# Altium schematic sheet ZYNQ_US_SOC_PL_GTX.SchDoc (part 2 of 3)
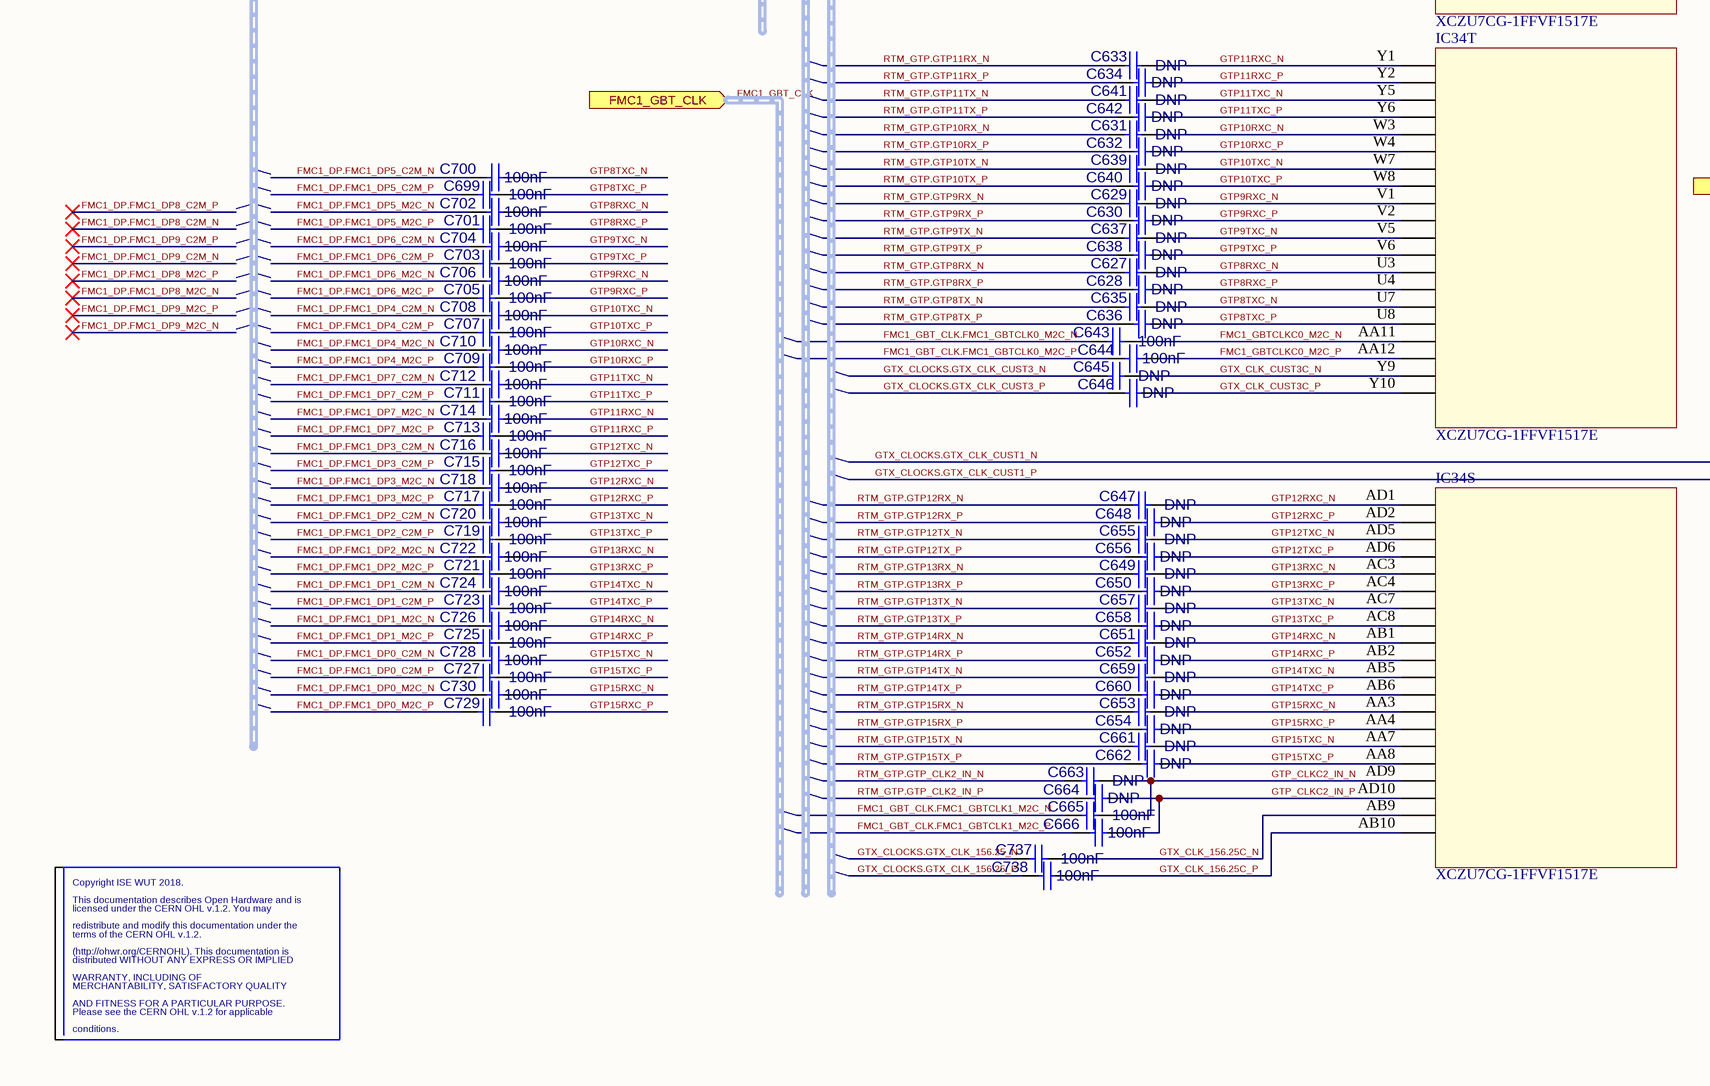
[diagram p3: ZYNQ_US_SOC_PL_GTX.SchDoc, bottom left]
## Library data of the parts
C176 = CAPC0603X33N: Capacitor - non polarized CAPC0603X33N DNP; Manufacturer Part Number: CC0201_100NF_6.3V_10%_X5R; Manufacturer: GENERIC; Part Description: SMD Multilayer Chip Ceramic Capacitor; CmpIndex: 1238; DXDB_LIBNAME: Capacitors SMD; Ref Designator: C176; SymIndex: 331; Tolerance: ±10%; Cell Name: CAPC0603X33N; Part Name: Capacitor - non polarized CAPC0603X33N; Part Number: Capacitor - non polarized CAPC0603X33N; Orientation: 0 = 0
C177 = CAPC0603X33N: Capacitor - non polarized CAPC0603X33N DNP; Manufacturer Part Number: CC0201_100NF_6.3V_10%_X5R; Manufacturer: GENERIC; Part Description: SMD Multilayer Chip Ceramic Capacitor; CmpIndex: 1240; DXDB_LIBNAME: Capacitors SMD; Ref Designator: C177; SymIndex: 331; Tolerance: ±10%; Cell Name: CAPC0603X33N; Part Name: Capacitor - non polarized CAPC0603X33N; Part Number: Capacitor - non polarized CAPC0603X33N; Orientation: 0 = 0
C178 = CAPC0603X33N: Capacitor - non polarized CAPC0603X33N DNP; Manufacturer Part Number: CC0201_100NF_6.3V_10%_X5R; Manufacturer: GENERIC; Part Description: SMD Multilayer Chip Ceramic Capacitor; CmpIndex: 1236; DXDB_LIBNAME: Capacitors SMD; Ref Designator: C178; SymIndex: 331; Tolerance: ±10%; Cell Name: CAPC0603X33N; Part Name: Capacitor - non polarized CAPC0603X33N; Part Number: Capacitor - non polarized CAPC0603X33N; Orientation: 0 = 0
C179 = CAPC0603X33N: Capacitor - non polarized CAPC0603X33N DNP; Manufacturer Part Number: CC0201_100NF_6.3V_10%_X5R; Manufacturer: GENERIC; Part Description: SMD Multilayer Chip Ceramic Capacitor; CmpIndex: 1241; DXDB_LIBNAME: Capacitors SMD; Ref Designator: C179; SymIndex: 331; Tolerance: ±10%; Cell Name: CAPC0603X33N; Part Name: Capacitor - non polarized CAPC0603X33N; Part Number: Capacitor - non polarized CAPC0603X33N; Orientation: 0 = 0
C181 = CAPC0603X33N: Capacitor - non polarized CAPC0603X33N DNP; Manufacturer Part Number: CC0201_100NF_6.3V_10%_X5R; Manufacturer: GENERIC; Part Description: SMD Multilayer Chip Ceramic Capacitor; CmpIndex: 1243; DXDB_LIBNAME: Capacitors SMD; Ref Designator: C181; SymIndex: 331; Tolerance: ±10%; Cell Name: CAPC0603X33N; Part Name: Capacitor - non polarized CAPC0603X33N; Part Number: Capacitor - non polarized CAPC0603X33N; Orientation: 0 = 0
C215 = CAPC0603X33N: Capacitor - non polarized CAPC0603X33N DNP; Manufacturer Part Number: CC0201_100NF_6.3V_10%_X5R; Manufacturer: GENERIC; Part Description: SMD Multilayer Chip Ceramic Capacitor; CmpIndex: 1242; DXDB_LIBNAME: Capacitors SMD; Ref Designator: C215; SymIndex: 331; Tolerance: ±10%; Cell Name: CAPC0603X33N; Part Name: Capacitor - non polarized CAPC0603X33N; Part Number: Capacitor - non polarized CAPC0603X33N; Orientation: 0 = 0
C264 = CAPC0603X33N: Capacitor - non polarized CAPC0603X33N DNP; Manufacturer Part Number: CC0201_100NF_6.3V_10%_X5R; Manufacturer: GENERIC; Part Description: SMD Multilayer Chip Ceramic Capacitor; CmpIndex: 1237; DXDB_LIBNAME: Capacitors SMD; Ref Designator: C264; SymIndex: 331; Tolerance: ±10%; Cell Name: CAPC0603X33N; Part Name: Capacitor - non polarized CAPC0603X33N; Part Number: Capacitor - non polarized CAPC0603X33N; Orientation: 0 = 0
C265 = CAPC0603X33N: Capacitor - non polarized CAPC0603X33N DNP; Manufacturer Part Number: CC0201_100NF_6.3V_10%_X5R; Manufacturer: GENERIC; Part Description: SMD Multilayer Chip Ceramic Capacitor; CmpIndex: 1239; DXDB_LIBNAME: Capacitors SMD; Ref Designator: C265; SymIndex: 331; Tolerance: ±10%; Cell Name: CAPC0603X33N; Part Name: Capacitor - non polarized CAPC0603X33N; Part Number: Capacitor - non polarized CAPC0603X33N; Orientation: 0 = 0
C266 = CAPC0603X33N: Capacitor - non polarized CAPC0603X33N DNP; Manufacturer Part Number: CC0201_100NF_6.3V_10%_X5R; Manufacturer: GENERIC; Part Description: SMD Multilayer Chip Ceramic Capacitor; CmpIndex: 1245; DXDB_LIBNAME: Capacitors SMD; Ref Designator: C266; SymIndex: 331; Tolerance: ±10%; Cell Name: CAPC0603X33N; Part Name: Capacitor - non polarized CAPC0603X33N; Part Number: Capacitor - non polarized CAPC0603X33N; Orientation: 0 = 0
C267 = CAPC0603X33N: Capacitor - non polarized CAPC0603X33N DNP; Manufacturer Part Number: CC0201_100NF_6.3V_10%_X5R; Manufacturer: GENERIC; Part Description: SMD Multilayer Chip Ceramic Capacitor; CmpIndex: 1246; DXDB_LIBNAME: Capacitors SMD; Ref Designator: C267; SymIndex: 331; Tolerance: ±10%; Cell Name: CAPC0603X33N; Part Name: Capacitor - non polarized CAPC0603X33N; Part Number: Capacitor - non polarized CAPC0603X33N; Orientation: 0 = 0
C268 = CAPC0603X33N: Capacitor - non polarized CAPC0603X33N DNP; Manufacturer Part Number: CC0201_100NF_6.3V_10%_X5R; Manufacturer: GENERIC; Part Description: SMD Multilayer Chip Ceramic Capacitor; CmpIndex: 1249; DXDB_LIBNAME: Capacitors SMD; Ref Designator: C268; SymIndex: 331; Tolerance: ±10%; Cell Name: CAPC0603X33N; Part Name: Capacitor - non polarized CAPC0603X33N; Part Number: Capacitor - non polarized CAPC0603X33N; Orientation: 0 = 0
C269 = CAPC0603X33N: Capacitor - non polarized CAPC0603X33N DNP; Manufacturer Part Number: CC0201_100NF_6.3V_10%_X5R; Manufacturer: GENERIC; Part Description: SMD Multilayer Chip Ceramic Capacitor; CmpIndex: 1250; DXDB_LIBNAME: Capacitors SMD; Ref Designator: C269; SymIndex: 331; Tolerance: ±10%; Cell Name: CAPC0603X33N; Part Name: Capacitor - non polarized CAPC0603X33N; Part Number: Capacitor - non polarized CAPC0603X33N; Orientation: 0 = 0
C270 = CAPC0603X33N: Capacitor - non polarized CAPC0603X33N DNP; Manufacturer Part Number: CC0201_100NF_6.3V_10%_X5R; Manufacturer: GENERIC; Part Description: SMD Multilayer Chip Ceramic Capacitor; CmpIndex: 1248; DXDB_LIBNAME: Capacitors SMD; Ref Designator: C270; SymIndex: 331; Tolerance: ±10%; Cell Name: CAPC0603X33N; Part Name: Capacitor - non polarized CAPC0603X33N; Part Number: Capacitor - non polarized CAPC0603X33N; Orientation: 0 = 0
C271 = CAPC0603X33N: Capacitor - non polarized CAPC0603X33N DNP; Manufacturer Part Number: CC0201_100NF_6.3V_10%_X5R; Manufacturer: GENERIC; Part Description: SMD Multilayer Chip Ceramic Capacitor; CmpIndex: 1244; DXDB_LIBNAME: Capacitors SMD; Ref Designator: C271; SymIndex: 331; Tolerance: ±10%; Cell Name: CAPC0603X33N; Part Name: Capacitor - non polarized CAPC0603X33N; Part Number: Capacitor - non polarized CAPC0603X33N; Orientation: 0 = 0
C272 = CAPC0603X33N: Capacitor - non polarized CAPC0603X33N DNP; Manufacturer Part Number: CC0201_100NF_6.3V_10%_X5R; Manufacturer: GENERIC; Part Description: SMD Multilayer Chip Ceramic Capacitor; CmpIndex: 1247; DXDB_LIBNAME: Capacitors SMD; Ref Designator: C272; SymIndex: 331; Tolerance: ±10%; Cell Name: CAPC0603X33N; Part Name: Capacitor - non polarized CAPC0603X33N; Part Number: Capacitor - non polarized CAPC0603X33N; Orientation: 0 = 0
C273 = CAPC0603X33N: Capacitor - non polarized CAPC0603X33N DNP; Manufacturer Part Number: CC0201_100NF_6.3V_10%_X5R; Manufacturer: GENERIC; Part Description: SMD Multilayer Chip Ceramic Capacitor; CmpIndex: 1251; DXDB_LIBNAME: Capacitors SMD; Ref Designator: C273; SymIndex: 331; Tolerance: ±10%; Cell Name: CAPC0603X33N; Part Name: Capacitor - non polarized CAPC0603X33N; Part Number: Capacitor - non polarized CAPC0603X33N; Orientation: 0 = 0
C579 = CAPC0603X33N: Capacitor - non polarized CAPC0603X33N DNP; Manufacturer Part Number: CC0201_100NF_6.3V_10%_X5R; Manufacturer: GENERIC; Part Description: SMD Multilayer Chip Ceramic Capacitor; CmpIndex: 654; DXDB_LIBNAME: Capacitors SMD; Ref Designator: C579; SymIndex: 331; Tolerance: ±10%; Cell Name: CAPC0603X33N; Part Name: Capacitor - non polarized CAPC0603X33N; Part Number: Capacitor - non polarized CAPC0603X33N; Orientation: 0 = 0
C580 = CAPC0603X33N: Capacitor - non polarized CAPC0603X33N DNP; Manufacturer Part Number: CC0201_100NF_6.3V_10%_X5R; Manufacturer: GENERIC; Part Description: SMD Multilayer Chip Ceramic Capacitor; CmpIndex: 706; DXDB_LIBNAME: Capacitors SMD; Ref Designator: C580; SymIndex: 331; Tolerance: ±10%; Cell Name: CAPC0603X33N; Part Name: Capacitor - non polarized CAPC0603X33N; Part Number: Capacitor - non polarized CAPC0603X33N; Orientation: 0 = 0
C581 = CAPC0603X33N: Capacitor - non polarized CAPC0603X33N DNP; Manufacturer Part Number: CC0201_100NF_6.3V_10%_X5R; Manufacturer: GENERIC; Part Description: SMD Multilayer Chip Ceramic Capacitor; CmpIndex: 707; DXDB_LIBNAME: Capacitors SMD; Ref Designator: C581; SymIndex: 331; Tolerance: ±10%; Cell Name: CAPC0603X33N; Part Name: Capacitor - non polarized CAPC0603X33N; Part Number: Capacitor - non polarized CAPC0603X33N; Orientation: 0 = 0
C582 = CAPC0603X33N: Capacitor - non polarized CAPC0603X33N DNP; Manufacturer Part Number: CC0201_100NF_6.3V_10%_X5R; Manufacturer: GENERIC; Part Description: SMD Multilayer Chip Ceramic Capacitor; CmpIndex: 731; DXDB_LIBNAME: Capacitors SMD; Ref Designator: C582; SymIndex: 331; Tolerance: ±10%; Cell Name: CAPC0603X33N; Part Name: Capacitor - non polarized CAPC0603X33N; Part Number: Capacitor - non polarized CAPC0603X33N; Orientation: 0 = 0
C583 = CAPC0603X33N: Capacitor - non polarized CAPC0603X33N DNP; Manufacturer Part Number: CC0201_100NF_6.3V_10%_X5R; Manufacturer: GENERIC; Part Description: SMD Multilayer Chip Ceramic Capacitor; CmpIndex: 763; DXDB_LIBNAME: Capacitors SMD; Ref Designator: C583; SymIndex: 331; Tolerance: ±10%; Cell Name: CAPC0603X33N; Part Name: Capacitor - non polarized CAPC0603X33N; Part Number: Capacitor - non polarized CAPC0603X33N; Orientation: 0 = 0
C584 = CAPC0603X33N: Capacitor - non polarized CAPC0603X33N DNP; Manufacturer Part Number: CC0201_100NF_6.3V_10%_X5R; Manufacturer: GENERIC; Part Description: SMD Multilayer Chip Ceramic Capacitor; CmpIndex: 764; DXDB_LIBNAME: Capacitors SMD; Ref Designator: C584; SymIndex: 331; Tolerance: ±10%; Cell Name: CAPC0603X33N; Part Name: Capacitor - non polarized CAPC0603X33N; Part Number: Capacitor - non polarized CAPC0603X33N; Orientation: 0 = 0
C585 = CAPC0603X33N: Capacitor - non polarized CAPC0603X33N DNP; Manufacturer Part Number: CC0201_100NF_6.3V_10%_X5R; Manufacturer: GENERIC; Part Description: SMD Multilayer Chip Ceramic Capacitor; CmpIndex: 765; DXDB_LIBNAME: Capacitors SMD; Ref Designator: C585; SymIndex: 331; Tolerance: ±10%; Cell Name: CAPC0603X33N; Part Name: Capacitor - non polarized CAPC0603X33N; Part Number: Capacitor - non polarized CAPC0603X33N; Orientation: 0 = 0
C586 = CAPC0603X33N: Capacitor - non polarized CAPC0603X33N DNP; Manufacturer Part Number: CC0201_100NF_6.3V_10%_X5R; Manufacturer: GENERIC; Part Description: SMD Multilayer Chip Ceramic Capacitor; CmpIndex: 766; DXDB_LIBNAME: Capacitors SMD; Ref Designator: C586; SymIndex: 331; Tolerance: ±10%; Cell Name: CAPC0603X33N; Part Name: Capacitor - non polarized CAPC0603X33N; Part Number: Capacitor - non polarized CAPC0603X33N; Orientation: 0 = 0
C587 = CAPC0603X33N: Capacitor - non polarized CAPC0603X33N DNP; Manufacturer Part Number: CC0201_100NF_6.3V_10%_X5R; Manufacturer: GENERIC; Part Description: SMD Multilayer Chip Ceramic Capacitor; CmpIndex: 767; DXDB_LIBNAME: Capacitors SMD; Ref Designator: C587; SymIndex: 331; Tolerance: ±10%; Cell Name: CAPC0603X33N; Part Name: Capacitor - non polarized CAPC0603X33N; Part Number: Capacitor - non polarized CAPC0603X33N; Orientation: 0 = 0
C588 = CAPC0603X33N: Capacitor - non polarized CAPC0603X33N DNP; Manufacturer Part Number: CC0201_100NF_6.3V_10%_X5R; Manufacturer: GENERIC; Part Description: SMD Multilayer Chip Ceramic Capacitor; CmpIndex: 768; DXDB_LIBNAME: Capacitors SMD; Ref Designator: C588; SymIndex: 331; Tolerance: ±10%; Cell Name: CAPC0603X33N; Part Name: Capacitor - non polarized CAPC0603X33N; Part Number: Capacitor - non polarized CAPC0603X33N; Orientation: 0 = 0
C589 = CAPC0603X33N: Capacitor - non polarized CAPC0603X33N DNP; Manufacturer Part Number: CC0201_100NF_6.3V_10%_X5R; Manufacturer: GENERIC; Part Description: SMD Multilayer Chip Ceramic Capacitor; CmpIndex: 769; DXDB_LIBNAME: Capacitors SMD; Ref Designator: C589; SymIndex: 331; Tolerance: ±10%; Cell Name: CAPC0603X33N; Part Name: Capacitor - non polarized CAPC0603X33N; Part Number: Capacitor - non polarized CAPC0603X33N; Orientation: 0 = 0
C590 = CAPC0603X33N: Capacitor - non polarized CAPC0603X33N DNP; Manufacturer Part Number: CC0201_100NF_6.3V_10%_X5R; Manufacturer: GENERIC; Part Description: SMD Multilayer Chip Ceramic Capacitor; CmpIndex: 770; DXDB_LIBNAME: Capacitors SMD; Ref Designator: C590; SymIndex: 331; Tolerance: ±10%; Cell Name: CAPC0603X33N; Part Name: Capacitor - non polarized CAPC0603X33N; Part Number: Capacitor - non polarized CAPC0603X33N; Orientation: 0 = 0
C591 = CAPC0603X33N: Capacitor - non polarized CAPC0603X33N DNP; Manufacturer Part Number: CC0201_100NF_6.3V_10%_X5R; Manufacturer: GENERIC; Part Description: SMD Multilayer Chip Ceramic Capacitor; CmpIndex: 771; DXDB_LIBNAME: Capacitors SMD; Ref Designator: C591; SymIndex: 331; Tolerance: ±10%; Cell Name: CAPC0603X33N; Part Name: Capacitor - non polarized CAPC0603X33N; Part Number: Capacitor - non polarized CAPC0603X33N; Orientation: 0 = 0
C592 = CAPC0603X33N: Capacitor - non polarized CAPC0603X33N DNP; Manufacturer Part Number: CC0201_100NF_6.3V_10%_X5R; Manufacturer: GENERIC; Part Description: SMD Multilayer Chip Ceramic Capacitor; CmpIndex: 772; DXDB_LIBNAME: Capacitors SMD; Ref Designator: C592; SymIndex: 331; Tolerance: ±10%; Cell Name: CAPC0603X33N; Part Name: Capacitor - non polarized CAPC0603X33N; Part Number: Capacitor - non polarized CAPC0603X33N; Orientation: 0 = 0
C593 = CAPC0603X33N: Capacitor - non polarized CAPC0603X33N DNP; Manufacturer Part Number: CC0201_100NF_6.3V_10%_X5R; Manufacturer: GENERIC; Part Description: SMD Multilayer Chip Ceramic Capacitor; CmpIndex: 773; DXDB_LIBNAME: Capacitors SMD; Ref Designator: C593; SymIndex: 331; Tolerance: ±10%; Cell Name: CAPC0603X33N; Part Name: Capacitor - non polarized CAPC0603X33N; Part Number: Capacitor - non polarized CAPC0603X33N; Orientation: 0 = 0
C594 = CAPC0603X33N: Capacitor - non polarized CAPC0603X33N DNP; Manufacturer Part Number: CC0201_100NF_6.3V_10%_X5R; Manufacturer: GENERIC; Part Description: SMD Multilayer Chip Ceramic Capacitor; CmpIndex: 774; DXDB_LIBNAME: Capacitors SMD; Ref Designator: C594; SymIndex: 331; Tolerance: ±10%; Cell Name: CAPC0603X33N; Part Name: Capacitor - non polarized CAPC0603X33N; Part Number: Capacitor - non polarized CAPC0603X33N; Orientation: 0 = 0
C595 = CAPC0603X33N: Capacitor - non polarized CAPC0603X33N 100nF; Manufacturer Part Number: CC0201_100NF_6.3V_10%_X5R; Manufacturer: GENERIC; Part Description: SMD Multilayer Chip Ceramic Capacitor; CmpIndex: 776; DXDB_LIBNAME: Capacitors SMD; Ref Designator: C595; SymIndex: 331; Tolerance: ±10%; Cell Name: CAPC0603X33N; Part Name: Capacitor - non polarized CAPC0603X33N; Part Number: Capacitor - non polarized CAPC0603X33N; Orientation: 0 = 0
C596 = CAPC0603X33N: Capacitor - non polarized CAPC0603X33N 100nF; Manufacturer Part Number: CC0201_100NF_6.3V_10%_X5R; Manufacturer: GENERIC; Part Description: SMD Multilayer Chip Ceramic Capacitor; CmpIndex: 775; DXDB_LIBNAME: Capacitors SMD; Ref Designator: C596; SymIndex: 331; Tolerance: ±10%; Cell Name: CAPC0603X33N; Part Name: Capacitor - non polarized CAPC0603X33N; Part Number: Capacitor - non polarized CAPC0603X33N; Orientation: 0 = 0
C597 = CAPC0603X33N: Capacitor - non polarized CAPC0603X33N DNP; Manufacturer Part Number: CC0201_100NF_6.3V_10%_X5R; Manufacturer: GENERIC; Part Description: SMD Multilayer Chip Ceramic Capacitor; CmpIndex: 777; DXDB_LIBNAME: Capacitors SMD; Ref Designator: C597; SymIndex: 331; Tolerance: ±10%; Cell Name: CAPC0603X33N; Part Name: Capacitor - non polarized CAPC0603X33N; Part Number: Capacitor - non polarized CAPC0603X33N; Orientation: 0 = 0
C598 = CAPC0603X33N: Capacitor - non polarized CAPC0603X33N DNP; Manufacturer Part Number: CC0201_100NF_6.3V_10%_X5R; Manufacturer: GENERIC; Part Description: SMD Multilayer Chip Ceramic Capacitor; CmpIndex: 778; DXDB_LIBNAME: Capacitors SMD; Ref Designator: C598; SymIndex: 331; Tolerance: ±10%; Cell Name: CAPC0603X33N; Part Name: Capacitor - non polarized CAPC0603X33N; Part Number: Capacitor - non polarized CAPC0603X33N; Orientation: 0 = 0
C599 = CAPC0603X33N: Capacitor - non polarized CAPC0603X33N 100nF; Manufacturer Part Number: CC0201_100NF_6.3V_10%_X5R; Manufacturer: GENERIC; Part Description: SMD Multilayer Chip Ceramic Capacitor; CmpIndex: 779; DXDB_LIBNAME: Capacitors SMD; Ref Designator: C599; SymIndex: 331; Tolerance: ±10%; Cell Name: CAPC0603X33N; Part Name: Capacitor - non polarized CAPC0603X33N; Part Number: Capacitor - non polarized CAPC0603X33N; Orientation: 0 = 0
C600 = CAPC0603X33N: Capacitor - non polarized CAPC0603X33N 100nF; Manufacturer Part Number: CC0201_100NF_6.3V_10%_X5R; Manufacturer: GENERIC; Part Description: SMD Multilayer Chip Ceramic Capacitor; CmpIndex: 780; DXDB_LIBNAME: Capacitors SMD; Ref Designator: C600; SymIndex: 331; Tolerance: ±10%; Cell Name: CAPC0603X33N; Part Name: Capacitor - non polarized CAPC0603X33N; Part Number: Capacitor - non polarized CAPC0603X33N; Orientation: 0 = 0
C601 = CAPC0603X33N: Capacitor - non polarized CAPC0603X33N 100nF; Manufacturer Part Number: CC0201_100NF_6.3V_10%_X5R; Manufacturer: GENERIC; Part Description: SMD Multilayer Chip Ceramic Capacitor; CmpIndex: 782; DXDB_LIBNAME: Capacitors SMD; Ref Designator: C601; SymIndex: 331; Tolerance: ±10%; Cell Name: CAPC0603X33N; Part Name: Capacitor - non polarized CAPC0603X33N; Part Number: Capacitor - non polarized CAPC0603X33N; Orientation: 0 = 0
C602 = CAPC0603X33N: Capacitor - non polarized CAPC0603X33N 100nF; Manufacturer Part Number: CC0201_100NF_6.3V_10%_X5R; Manufacturer: GENERIC; Part Description: SMD Multilayer Chip Ceramic Capacitor; CmpIndex: 781; DXDB_LIBNAME: Capacitors SMD; Ref Designator: C602; SymIndex: 331; Tolerance: ±10%; Cell Name: CAPC0603X33N; Part Name: Capacitor - non polarized CAPC0603X33N; Part Number: Capacitor - non polarized CAPC0603X33N; Orientation: 0 = 0
C603 = CAPC0603X33N: Capacitor - non polarized CAPC0603X33N 100nF; Manufacturer Part Number: CC0201_100NF_6.3V_10%_X5R; Manufacturer: GENERIC; Part Description: SMD Multilayer Chip Ceramic Capacitor; CmpIndex: 784; DXDB_LIBNAME: Capacitors SMD; Ref Designator: C603; SymIndex: 331; Tolerance: ±10%; Cell Name: CAPC0603X33N; Part Name: Capacitor - non polarized CAPC0603X33N; Part Number: Capacitor - non polarized CAPC0603X33N; Orientation: 0 = 0
C604 = CAPC0603X33N: Capacitor - non polarized CAPC0603X33N 100nF; Manufacturer Part Number: CC0201_100NF_6.3V_10%_X5R; Manufacturer: GENERIC; Part Description: SMD Multilayer Chip Ceramic Capacitor; CmpIndex: 783; DXDB_LIBNAME: Capacitors SMD; Ref Designator: C604; SymIndex: 331; Tolerance: ±10%; Cell Name: CAPC0603X33N; Part Name: Capacitor - non polarized CAPC0603X33N; Part Number: Capacitor - non polarized CAPC0603X33N; Orientation: 0 = 0
C605 = CAPC0603X33N: Capacitor - non polarized CAPC0603X33N 100nF; Manufacturer Part Number: CC0201_100NF_6.3V_10%_X5R; Manufacturer: GENERIC; Part Description: SMD Multilayer Chip Ceramic Capacitor; CmpIndex: 785; DXDB_LIBNAME: Capacitors SMD; Ref Designator: C605; SymIndex: 331; Tolerance: ±10%; Cell Name: CAPC0603X33N; Part Name: Capacitor - non polarized CAPC0603X33N; Part Number: Capacitor - non polarized CAPC0603X33N; Orientation: 0 = 0
C606 = CAPC0603X33N: Capacitor - non polarized CAPC0603X33N 100nF; Manufacturer Part Number: CC0201_100NF_6.3V_10%_X5R; Manufacturer: GENERIC; Part Description: SMD Multilayer Chip Ceramic Capacitor; CmpIndex: 786; DXDB_LIBNAME: Capacitors SMD; Ref Designator: C606; SymIndex: 331; Tolerance: ±10%; Cell Name: CAPC0603X33N; Part Name: Capacitor - non polarized CAPC0603X33N; Part Number: Capacitor - non polarized CAPC0603X33N; Orientation: 0 = 0
C607 = CAPC0603X33N: Capacitor - non polarized CAPC0603X33N DNP; Manufacturer Part Number: CC0201_100NF_6.3V_10%_X5R; Manufacturer: GENERIC; Part Description: SMD Multilayer Chip Ceramic Capacitor; CmpIndex: 793; DXDB_LIBNAME: Capacitors SMD; Ref Designator: C607; SymIndex: 331; Tolerance: ±10%; Cell Name: CAPC0603X33N; Part Name: Capacitor - non polarized CAPC0603X33N; Part Number: Capacitor - non polarized CAPC0603X33N; Orientation: 0 = 0
C608 = CAPC0603X33N: Capacitor - non polarized CAPC0603X33N DNP; Manufacturer Part Number: CC0201_100NF_6.3V_10%_X5R; Manufacturer: GENERIC; Part Description: SMD Multilayer Chip Ceramic Capacitor; CmpIndex: 794; DXDB_LIBNAME: Capacitors SMD; Ref Designator: C608; SymIndex: 331; Tolerance: ±10%; Cell Name: CAPC0603X33N; Part Name: Capacitor - non polarized CAPC0603X33N; Part Number: Capacitor - non polarized CAPC0603X33N; Orientation: 0 = 0
C609 = CAPC0603X33N: Capacitor - non polarized CAPC0603X33N DNP; Manufacturer Part Number: CC0201_100NF_6.3V_10%_X5R; Manufacturer: GENERIC; Part Description: SMD Multilayer Chip Ceramic Capacitor; CmpIndex: 795; DXDB_LIBNAME: Capacitors SMD; Ref Designator: C609; SymIndex: 331; Tolerance: ±10%; Cell Name: CAPC0603X33N; Part Name: Capacitor - non polarized CAPC0603X33N; Part Number: Capacitor - non polarized CAPC0603X33N; Orientation: 0 = 0
C610 = CAPC0603X33N: Capacitor - non polarized CAPC0603X33N DNP; Manufacturer Part Number: CC0201_100NF_6.3V_10%_X5R; Manufacturer: GENERIC; Part Description: SMD Multilayer Chip Ceramic Capacitor; CmpIndex: 796; DXDB_LIBNAME: Capacitors SMD; Ref Designator: C610; SymIndex: 331; Tolerance: ±10%; Cell Name: CAPC0603X33N; Part Name: Capacitor - non polarized CAPC0603X33N; Part Number: Capacitor - non polarized CAPC0603X33N; Orientation: 0 = 0
C611 = CAPC0603X33N: Capacitor - non polarized CAPC0603X33N DNP; Manufacturer Part Number: CC0201_100NF_6.3V_10%_X5R; Manufacturer: GENERIC; Part Description: SMD Multilayer Chip Ceramic Capacitor; CmpIndex: 797; DXDB_LIBNAME: Capacitors SMD; Ref Designator: C611; SymIndex: 331; Tolerance: ±10%; Cell Name: CAPC0603X33N; Part Name: Capacitor - non polarized CAPC0603X33N; Part Number: Capacitor - non polarized CAPC0603X33N; Orientation: 0 = 0
C612 = CAPC0603X33N: Capacitor - non polarized CAPC0603X33N DNP; Manufacturer Part Number: CC0201_100NF_6.3V_10%_X5R; Manufacturer: GENERIC; Part Description: SMD Multilayer Chip Ceramic Capacitor; CmpIndex: 798; DXDB_LIBNAME: Capacitors SMD; Ref Designator: C612; SymIndex: 331; Tolerance: ±10%; Cell Name: CAPC0603X33N; Part Name: Capacitor - non polarized CAPC0603X33N; Part Number: Capacitor - non polarized CAPC0603X33N; Orientation: 0 = 0
C613 = CAPC0603X33N: Capacitor - non polarized CAPC0603X33N DNP; Manufacturer Part Number: CC0201_100NF_6.3V_10%_X5R; Manufacturer: GENERIC; Part Description: SMD Multilayer Chip Ceramic Capacitor; CmpIndex: 799; DXDB_LIBNAME: Capacitors SMD; Ref Designator: C613; SymIndex: 331; Tolerance: ±10%; Cell Name: CAPC0603X33N; Part Name: Capacitor - non polarized CAPC0603X33N; Part Number: Capacitor - non polarized CAPC0603X33N; Orientation: 0 = 0
C614 = CAPC0603X33N: Capacitor - non polarized CAPC0603X33N DNP; Manufacturer Part Number: CC0201_100NF_6.3V_10%_X5R; Manufacturer: GENERIC; Part Description: SMD Multilayer Chip Ceramic Capacitor; CmpIndex: 800; DXDB_LIBNAME: Capacitors SMD; Ref Designator: C614; SymIndex: 331; Tolerance: ±10%; Cell Name: CAPC0603X33N; Part Name: Capacitor - non polarized CAPC0603X33N; Part Number: Capacitor - non polarized CAPC0603X33N; Orientation: 0 = 0
C615 = CAPC0603X33N: Capacitor - non polarized CAPC0603X33N DNP; Manufacturer Part Number: CC0201_100NF_6.3V_10%_X5R; Manufacturer: GENERIC; Part Description: SMD Multilayer Chip Ceramic Capacitor; CmpIndex: 801; DXDB_LIBNAME: Capacitors SMD; Ref Designator: C615; SymIndex: 331; Tolerance: ±10%; Cell Name: CAPC0603X33N; Part Name: Capacitor - non polarized CAPC0603X33N; Part Number: Capacitor - non polarized CAPC0603X33N; Orientation: 0 = 0
C616 = CAPC0603X33N: Capacitor - non polarized CAPC0603X33N DNP; Manufacturer Part Number: CC0201_100NF_6.3V_10%_X5R; Manufacturer: GENERIC; Part Description: SMD Multilayer Chip Ceramic Capacitor; CmpIndex: 802; DXDB_LIBNAME: Capacitors SMD; Ref Designator: C616; SymIndex: 331; Tolerance: ±10%; Cell Name: CAPC0603X33N; Part Name: Capacitor - non polarized CAPC0603X33N; Part Number: Capacitor - non polarized CAPC0603X33N; Orientation: 0 = 0
C617 = CAPC0603X33N: Capacitor - non polarized CAPC0603X33N DNP; Manufacturer Part Number: CC0201_100NF_6.3V_10%_X5R; Manufacturer: GENERIC; Part Description: SMD Multilayer Chip Ceramic Capacitor; CmpIndex: 803; DXDB_LIBNAME: Capacitors SMD; Ref Designator: C617; SymIndex: 331; Tolerance: ±10%; Cell Name: CAPC0603X33N; Part Name: Capacitor - non polarized CAPC0603X33N; Part Number: Capacitor - non polarized CAPC0603X33N; Orientation: 0 = 0
C618 = CAPC0603X33N: Capacitor - non polarized CAPC0603X33N DNP; Manufacturer Part Number: CC0201_100NF_6.3V_10%_X5R; Manufacturer: GENERIC; Part Description: SMD Multilayer Chip Ceramic Capacitor; CmpIndex: 804; DXDB_LIBNAME: Capacitors SMD; Ref Designator: C618; SymIndex: 331; Tolerance: ±10%; Cell Name: CAPC0603X33N; Part Name: Capacitor - non polarized CAPC0603X33N; Part Number: Capacitor - non polarized CAPC0603X33N; Orientation: 0 = 0
C619 = CAPC0603X33N: Capacitor - non polarized CAPC0603X33N DNP; Manufacturer Part Number: CC0201_100NF_6.3V_10%_X5R; Manufacturer: GENERIC; Part Description: SMD Multilayer Chip Ceramic Capacitor; CmpIndex: 805; DXDB_LIBNAME: Capacitors SMD; Ref Designator: C619; SymIndex: 331; Tolerance: ±10%; Cell Name: CAPC0603X33N; Part Name: Capacitor - non polarized CAPC0603X33N; Part Number: Capacitor - non polarized CAPC0603X33N; Orientation: 0 = 0
C620 = CAPC0603X33N: Capacitor - non polarized CAPC0603X33N DNP; Manufacturer Part Number: CC0201_100NF_6.3V_10%_X5R; Manufacturer: GENERIC; Part Description: SMD Multilayer Chip Ceramic Capacitor; CmpIndex: 806; DXDB_LIBNAME: Capacitors SMD; Ref Designator: C620; SymIndex: 331; Tolerance: ±10%; Cell Name: CAPC0603X33N; Part Name: Capacitor - non polarized CAPC0603X33N; Part Number: Capacitor - non polarized CAPC0603X33N; Orientation: 0 = 0
C621 = CAPC0603X33N: Capacitor - non polarized CAPC0603X33N DNP; Manufacturer Part Number: CC0201_100NF_6.3V_10%_X5R; Manufacturer: GENERIC; Part Description: SMD Multilayer Chip Ceramic Capacitor; CmpIndex: 787; DXDB_LIBNAME: Capacitors SMD; Ref Designator: C621; SymIndex: 331; Tolerance: ±10%; Cell Name: CAPC0603X33N; Part Name: Capacitor - non polarized CAPC0603X33N; Part Number: Capacitor - non polarized CAPC0603X33N; Orientation: 0 = 0
C622 = CAPC0603X33N: Capacitor - non polarized CAPC0603X33N DNP; Manufacturer Part Number: CC0201_100NF_6.3V_10%_X5R; Manufacturer: GENERIC; Part Description: SMD Multilayer Chip Ceramic Capacitor; CmpIndex: 788; DXDB_LIBNAME: Capacitors SMD; Ref Designator: C622; SymIndex: 331; Tolerance: ±10%; Cell Name: CAPC0603X33N; Part Name: Capacitor - non polarized CAPC0603X33N; Part Number: Capacitor - non polarized CAPC0603X33N; Orientation: 0 = 0
C623 = CAPC0603X33N: Capacitor - non polarized CAPC0603X33N 100nF; Manufacturer Part Number: CC0201_100NF_6.3V_10%_X5R; Manufacturer: GENERIC; Part Description: SMD Multilayer Chip Ceramic Capacitor; CmpIndex: 789; DXDB_LIBNAME: Capacitors SMD; Ref Designator: C623; SymIndex: 331; Tolerance: ±10%; Cell Name: CAPC0603X33N; Part Name: Capacitor - non polarized CAPC0603X33N; Part Number: Capacitor - non polarized CAPC0603X33N; Orientation: 0 = 0
C624 = CAPC0603X33N: Capacitor - non polarized CAPC0603X33N 100nF; Manufacturer Part Number: CC0201_100NF_6.3V_10%_X5R; Manufacturer: GENERIC; Part Description: SMD Multilayer Chip Ceramic Capacitor; CmpIndex: 790; DXDB_LIBNAME: Capacitors SMD; Ref Designator: C624; SymIndex: 331; Tolerance: ±10%; Cell Name: CAPC0603X33N; Part Name: Capacitor - non polarized CAPC0603X33N; Part Number: Capacitor - non polarized CAPC0603X33N; Orientation: 0 = 0
C625 = CAPC0603X33N: Capacitor - non polarized CAPC0603X33N 100nF; Manufacturer Part Number: CC0201_100NF_6.3V_10%_X5R; Manufacturer: GENERIC; Part Description: SMD Multilayer Chip Ceramic Capacitor; CmpIndex: 791; DXDB_LIBNAME: Capacitors SMD; Ref Designator: C625; SymIndex: 331; Tolerance: ±10%; Cell Name: CAPC0603X33N; Part Name: Capacitor - non polarized CAPC0603X33N; Part Number: Capacitor - non polarized CAPC0603X33N; Orientation: 0 = 0
C626 = CAPC0603X33N: Capacitor - non polarized CAPC0603X33N 100nF; Manufacturer Part Number: CC0201_100NF_6.3V_10%_X5R; Manufacturer: GENERIC; Part Description: SMD Multilayer Chip Ceramic Capacitor; CmpIndex: 792; DXDB_LIBNAME: Capacitors SMD; Ref Designator: C626; SymIndex: 331; Tolerance: ±10%; Cell Name: CAPC0603X33N; Part Name: Capacitor - non polarized CAPC0603X33N; Part Number: Capacitor - non polarized CAPC0603X33N; Orientation: 0 = 0
C627 = CAPC0603X33N: Capacitor - non polarized CAPC0603X33N DNP; Manufacturer Part Number: CC0201_100NF_6.3V_10%_X5R; Manufacturer: GENERIC; Part Description: SMD Multilayer Chip Ceramic Capacitor; CmpIndex: 808; DXDB_LIBNAME: Capacitors SMD; Ref Designator: C627; SymIndex: 331; Tolerance: ±10%; Cell Name: CAPC0603X33N; Part Name: Capacitor - non polarized CAPC0603X33N; Part Number: Capacitor - non polarized CAPC0603X33N; Orientation: 0 = 0
C628 = CAPC0603X33N: Capacitor - non polarized CAPC0603X33N DNP; Manufacturer Part Number: CC0201_100NF_6.3V_10%_X5R; Manufacturer: GENERIC; Part Description: SMD Multilayer Chip Ceramic Capacitor; CmpIndex: 807; DXDB_LIBNAME: Capacitors SMD; Ref Designator: C628; SymIndex: 331; Tolerance: ±10%; Cell Name: CAPC0603X33N; Part Name: Capacitor - non polarized CAPC0603X33N; Part Number: Capacitor - non polarized CAPC0603X33N; Orientation: 0 = 0
C629 = CAPC0603X33N: Capacitor - non polarized CAPC0603X33N DNP; Manufacturer Part Number: CC0201_100NF_6.3V_10%_X5R; Manufacturer: GENERIC; Part Description: SMD Multilayer Chip Ceramic Capacitor; CmpIndex: 809; DXDB_LIBNAME: Capacitors SMD; Ref Designator: C629; SymIndex: 331; Tolerance: ±10%; Cell Name: CAPC0603X33N; Part Name: Capacitor - non polarized CAPC0603X33N; Part Number: Capacitor - non polarized CAPC0603X33N; Orientation: 0 = 0
C630 = CAPC0603X33N: Capacitor - non polarized CAPC0603X33N DNP; Manufacturer Part Number: CC0201_100NF_6.3V_10%_X5R; Manufacturer: GENERIC; Part Description: SMD Multilayer Chip Ceramic Capacitor; CmpIndex: 816; DXDB_LIBNAME: Capacitors SMD; Ref Designator: C630; SymIndex: 331; Tolerance: ±10%; Cell Name: CAPC0603X33N; Part Name: Capacitor - non polarized CAPC0603X33N; Part Number: Capacitor - non polarized CAPC0603X33N; Orientation: 0 = 0
C631 = CAPC0603X33N: Capacitor - non polarized CAPC0603X33N DNP; Manufacturer Part Number: CC0201_100NF_6.3V_10%_X5R; Manufacturer: GENERIC; Part Description: SMD Multilayer Chip Ceramic Capacitor; CmpIndex: 817; DXDB_LIBNAME: Capacitors SMD; Ref Designator: C631; SymIndex: 331; Tolerance: ±10%; Cell Name: CAPC0603X33N; Part Name: Capacitor - non polarized CAPC0603X33N; Part Number: Capacitor - non polarized CAPC0603X33N; Orientation: 0 = 0
C632 = CAPC0603X33N: Capacitor - non polarized CAPC0603X33N DNP; Manufacturer Part Number: CC0201_100NF_6.3V_10%_X5R; Manufacturer: GENERIC; Part Description: SMD Multilayer Chip Ceramic Capacitor; CmpIndex: 818; DXDB_LIBNAME: Capacitors SMD; Ref Designator: C632; SymIndex: 331; Tolerance: ±10%; Cell Name: CAPC0603X33N; Part Name: Capacitor - non polarized CAPC0603X33N; Part Number: Capacitor - non polarized CAPC0603X33N; Orientation: 0 = 0
C633 = CAPC0603X33N: Capacitor - non polarized CAPC0603X33N DNP; Manufacturer Part Number: CC0201_100NF_6.3V_10%_X5R; Manufacturer: GENERIC; Part Description: SMD Multilayer Chip Ceramic Capacitor; CmpIndex: 819; DXDB_LIBNAME: Capacitors SMD; Ref Designator: C633; SymIndex: 331; Tolerance: ±10%; Cell Name: CAPC0603X33N; Part Name: Capacitor - non polarized CAPC0603X33N; Part Number: Capacitor - non polarized CAPC0603X33N; Orientation: 0 = 0
C634 = CAPC0603X33N: Capacitor - non polarized CAPC0603X33N DNP; Manufacturer Part Number: CC0201_100NF_6.3V_10%_X5R; Manufacturer: GENERIC; Part Description: SMD Multilayer Chip Ceramic Capacitor; CmpIndex: 820; DXDB_LIBNAME: Capacitors SMD; Ref Designator: C634; SymIndex: 331; Tolerance: ±10%; Cell Name: CAPC0603X33N; Part Name: Capacitor - non polarized CAPC0603X33N; Part Number: Capacitor - non polarized CAPC0603X33N; Orientation: 0 = 0
C635 = CAPC0603X33N: Capacitor - non polarized CAPC0603X33N DNP; Manufacturer Part Number: CC0201_100NF_6.3V_10%_X5R; Manufacturer: GENERIC; Part Description: SMD Multilayer Chip Ceramic Capacitor; CmpIndex: 821; DXDB_LIBNAME: Capacitors SMD; Ref Designator: C635; SymIndex: 331; Tolerance: ±10%; Cell Name: CAPC0603X33N; Part Name: Capacitor - non polarized CAPC0603X33N; Part Number: Capacitor - non polarized CAPC0603X33N; Orientation: 0 = 0
C636 = CAPC0603X33N: Capacitor - non polarized CAPC0603X33N DNP; Manufacturer Part Number: CC0201_100NF_6.3V_10%_X5R; Manufacturer: GENERIC; Part Description: SMD Multilayer Chip Ceramic Capacitor; CmpIndex: 810; DXDB_LIBNAME: Capacitors SMD; Ref Designator: C636; SymIndex: 331; Tolerance: ±10%; Cell Name: CAPC0603X33N; Part Name: Capacitor - non polarized CAPC0603X33N; Part Number: Capacitor - non polarized CAPC0603X33N; Orientation: 0 = 0
C637 = CAPC0603X33N: Capacitor - non polarized CAPC0603X33N DNP; Manufacturer Part Number: CC0201_100NF_6.3V_10%_X5R; Manufacturer: GENERIC; Part Description: SMD Multilayer Chip Ceramic Capacitor; CmpIndex: 811; DXDB_LIBNAME: Capacitors SMD; Ref Designator: C637; SymIndex: 331; Tolerance: ±10%; Cell Name: CAPC0603X33N; Part Name: Capacitor - non polarized CAPC0603X33N; Part Number: Capacitor - non polarized CAPC0603X33N; Orientation: 0 = 0
C638 = CAPC0603X33N: Capacitor - non polarized CAPC0603X33N DNP; Manufacturer Part Number: CC0201_100NF_6.3V_10%_X5R; Manufacturer: GENERIC; Part Description: SMD Multilayer Chip Ceramic Capacitor; CmpIndex: 812; DXDB_LIBNAME: Capacitors SMD; Ref Designator: C638; SymIndex: 331; Tolerance: ±10%; Cell Name: CAPC0603X33N; Part Name: Capacitor - non polarized CAPC0603X33N; Part Number: Capacitor - non polarized CAPC0603X33N; Orientation: 0 = 0
C639 = CAPC0603X33N: Capacitor - non polarized CAPC0603X33N DNP; Manufacturer Part Number: CC0201_100NF_6.3V_10%_X5R; Manufacturer: GENERIC; Part Description: SMD Multilayer Chip Ceramic Capacitor; CmpIndex: 813; DXDB_LIBNAME: Capacitors SMD; Ref Designator: C639; SymIndex: 331; Tolerance: ±10%; Cell Name: CAPC0603X33N; Part Name: Capacitor - non polarized CAPC0603X33N; Part Number: Capacitor - non polarized CAPC0603X33N; Orientation: 0 = 0
C640 = CAPC0603X33N: Capacitor - non polarized CAPC0603X33N DNP; Manufacturer Part Number: CC0201_100NF_6.3V_10%_X5R; Manufacturer: GENERIC; Part Description: SMD Multilayer Chip Ceramic Capacitor; CmpIndex: 814; DXDB_LIBNAME: Capacitors SMD; Ref Designator: C640; SymIndex: 331; Tolerance: ±10%; Cell Name: CAPC0603X33N; Part Name: Capacitor - non polarized CAPC0603X33N; Part Number: Capacitor - non polarized CAPC0603X33N; Orientation: 0 = 0
C641 = CAPC0603X33N: Capacitor - non polarized CAPC0603X33N DNP; Manufacturer Part Number: CC0201_100NF_6.3V_10%_X5R; Manufacturer: GENERIC; Part Description: SMD Multilayer Chip Ceramic Capacitor; CmpIndex: 815; DXDB_LIBNAME: Capacitors SMD; Ref Designator: C641; SymIndex: 331; Tolerance: ±10%; Cell Name: CAPC0603X33N; Part Name: Capacitor - non polarized CAPC0603X33N; Part Number: Capacitor - non polarized CAPC0603X33N; Orientation: 0 = 0
C642 = CAPC0603X33N: Capacitor - non polarized CAPC0603X33N DNP; Manufacturer Part Number: CC0201_100NF_6.3V_10%_X5R; Manufacturer: GENERIC; Part Description: SMD Multilayer Chip Ceramic Capacitor; CmpIndex: 822; DXDB_LIBNAME: Capacitors SMD; Ref Designator: C642; SymIndex: 331; Tolerance: ±10%; Cell Name: CAPC0603X33N; Part Name: Capacitor - non polarized CAPC0603X33N; Part Number: Capacitor - non polarized CAPC0603X33N; Orientation: 0 = 0